# EasyEDA Pro project ProProject_Avaota Pi A_2024-03-25.epro, board PCB1 (continued)
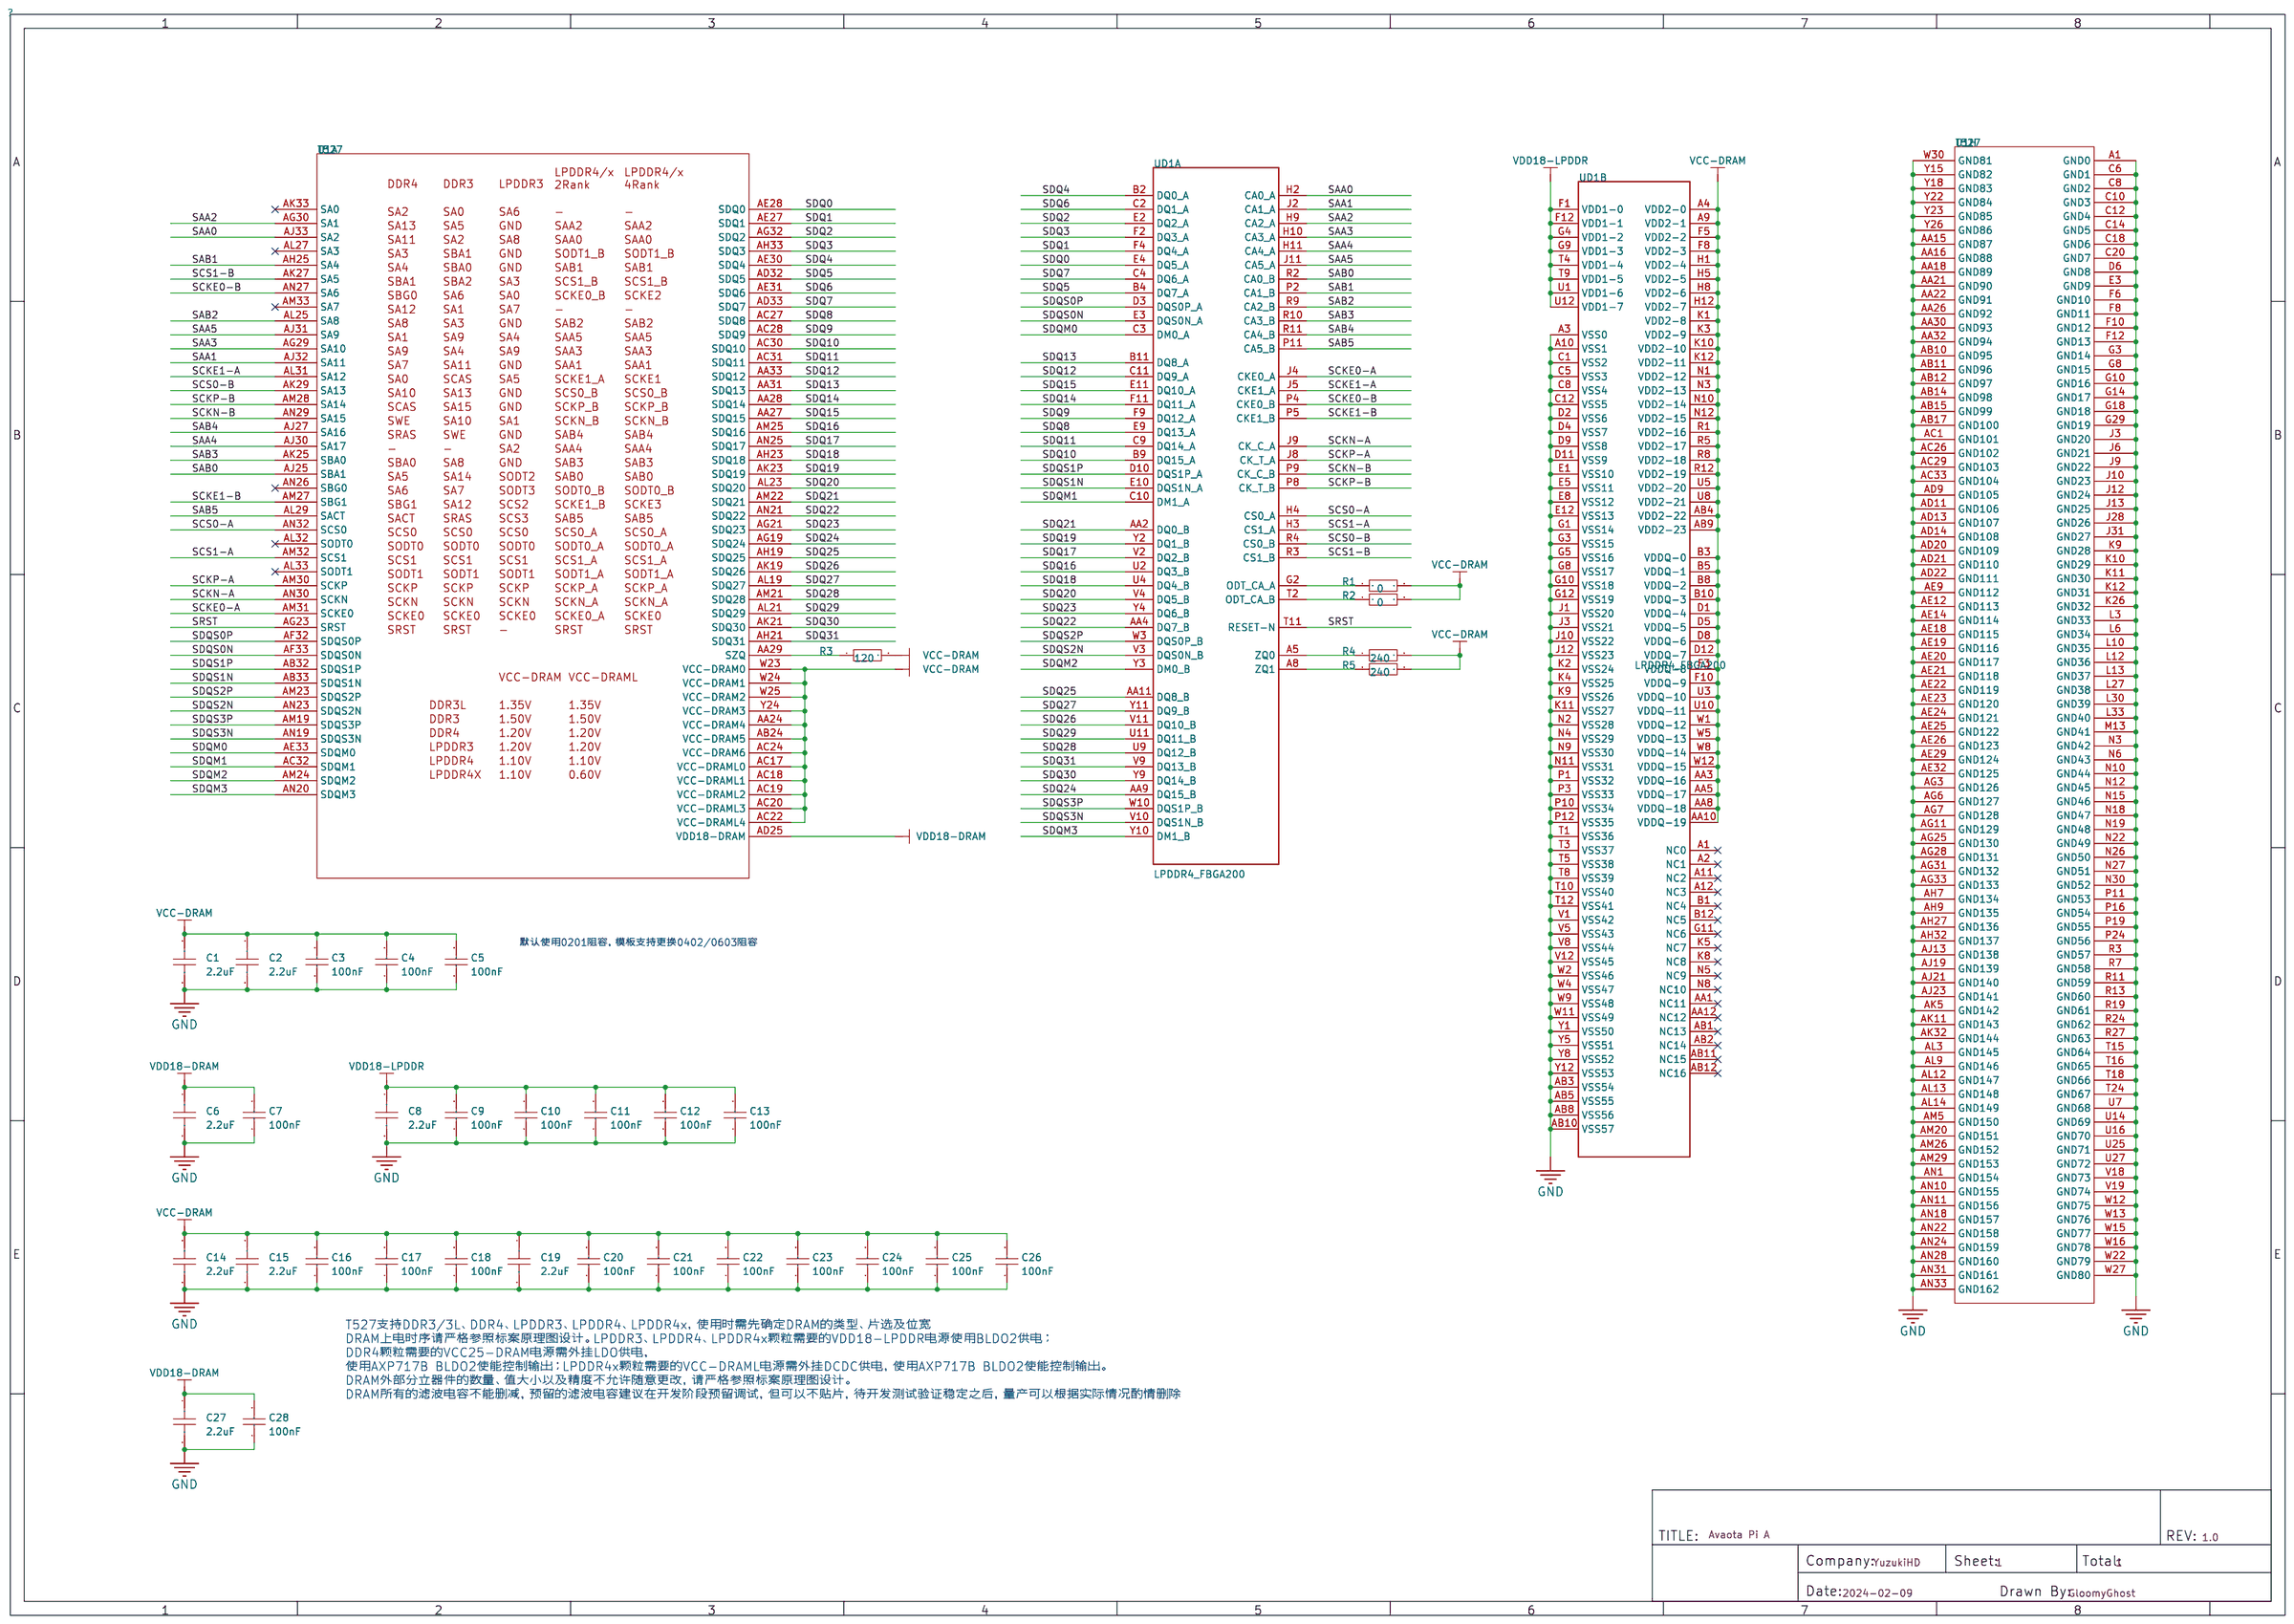
[diagram p0: schematic sheet]
## Routing (per net, layer and track width the routed paths; a pad name or vN(x,y) marks a point on that pad's centre or on a via; arc(x,y) is an arc through that point) (continued)
LCD0-D20: length 77
  Top Layer w0.102: v2(65.95,42.63) 65.92,42.63 U14.J29
  Inner5 w0.127: v2(30.33,26.52) 33.63,26.52 35.08,27.97 45.09,27.97 47.42,30.3 63.58,30.3 67.31,34.04 67.31,38.1 68.33,39.12 68.33,39.42 67.31,40.44 67.31,42.34 67.16,42.49 66.08,42.49 v2(65.95,42.63)
  Bottom Layer w0.127: FPC1.27 16.73,24.78 18.47,26.52 v2(30.33,26.52)
LCD0-D21: length 71.5
  Top Layer w0.102: U14.J30 65.92,42.13 v2(65.95,42.13)
  内层4 w0.127: v2(65.95,42.13) 66.32,41.76 66.32,38.84 65.53,38.05 65.53,37.24 60.68,32.39 57.66,32.39 56.92,31.65 40.46,31.65 35.84,27.03 31.67,27.03 v2(30.73,26.09)
  Bottom Layer w0.127: v2(30.73,26.09) 18.72,26.09 16.91,24.28 FPC1.28
LCD0-D22: length 70
  Top Layer w0.076: 65.44,40.65 65.44,40.51 65.69,40.26 65.69,39.26
  Top Layer w0.102: v2(27.3,25.6) 28.27,25.6 28.93,24.94 43.36,24.94 49.61,31.19 54.71,31.19 56.34,32.82 61.04,32.82 62.76,34.54 62.94,34.54 64.57,36.17 64.67,36.17 65.84,37.34 65.84,39.11 65.69,39.26
  Bottom Layer w0.127: FPC1.29 17.17,23.78 19,25.6 v2(27.3,25.6)
LCD0-D23: length 71.1
  Top Layer w0.076: 65.44,40.14 65.48,39.99 65.49,39.48 65.46,39.2 65.58,38.97
  Top Layer w0.102: 65.58,38.97 65.58,37.43 64.57,36.42 64.49,36.42 62.86,34.8 62.64,34.8 60.91,33.07 56.13,33.07 54.56,31.5 49.45,31.5 43.21,25.25 29.13,25.25 28.4,25.98 27.15,25.98 26.92,25.76 26.92,25.43 27.2,25.15 v2(27.71,25.15)
  Bottom Layer w0.127: FPC1.30 17.36,23.28 19.23,25.15 v2(27.71,25.15)
LCD0-DE: length 74.2
  Top Layer w0.076: 65,38.46 65,39.05 65.04,39.65 65.04,39.66 65.02,39.95 65.04,40.17 65.04,40.36 64.94,40.65 65,40.59
  Top Layer w0.102: v2(64.39,37.21) 65,37.83 65,38.46
  Inner5 w0.127: v2(64.39,37.21) 64.39,36.5 61.67,33.78 45.75,33.78 43.15,31.19 29.03,31.19 26.49,28.65 26.49,23.14 25.27,21.92 v2(23.44,21.92)
  Bottom Layer w0.127: FPC1.40 6.95,18.28 9.12,20.45 19.43,20.45 20.9,21.92 v2(23.44,21.92)
LCD0-HSYNC: length 84.3
  Top Layer w0.127: v2(64.95,42.65) U14.L28
  Inner5 w0.127: v2(64.95,42.65) 65.33,43.03 66.19,43.03 66.47,42.75 67.28,42.75 67.57,42.46 67.57,40.76 68.63,39.7 68.63,38.81 67.67,37.85 67.67,33.73 63.81,29.87 47.62,29.87 45.31,27.56 35.33,27.56 33.86,26.09 31.45,26.09 30.99,25.63 30.48,25.63 29.97,26.14 27.18,26.14 26.87,25.83 26.87,22.81 25.6,21.54 23.77,21.54 23.27,21.03 v2(22.45,21.03)
  Bottom Layer w0.127: FPC1.42 7.14,17.28 9.58,19.71 20.04,19.71 21.36,21.03 v2(22.45,21.03)
LCD0-PWM: length 77.5
  Top Layer w0.076: 64.44,41.15 64.69,40.9 64.69,40.62 64.72,40.52 64.77,40.45 64.86,40.16 64.79,39.57 64.8,39.26 64.8,39.25
  Top Layer w0.102: v2(64.24,37.77) 64.24,38.1 64.8,38.66 64.8,39.27
  内层2 w0.127: v2(64.24,37.77) 63.14,37.77 60.81,35.43 56.03,35.43 53.29,32.69 42.54,32.69 41.48,33.76 40.97,33.76 40.03,32.82 37.8,32.82 36.68,33.93 36.68,34.95 36.19,35.43 31.09,35.43 27.69,32.03 27.69,26.04 28.12,25.6 v2(28.12,24.66)
  Bottom Layer w0.127: FPC1.32 6.63,22.28 7.19,22.83 17.58,22.83 19.41,24.66 v2(28.12,24.66)
LCD0-RST: length 76.4
  Top Layer w0.076: 64.44,39.02 64.5,39.64 64.6,39.87 64.67,39.99 64.69,40.17 64.63,40.37 64.43,40.61
  Top Layer w0.102: v2(63.88,37.36) 63.88,38.13 64.44,38.68 64.44,39.03
  内层2 w0.127: v2(63.88,37.36) 63.3,37.36 61.01,35.08 56.26,35.08 53.47,32.28 37.85,32.28 36.3,33.83 36.3,34.77 35.99,35.08 31.27,35.08 28.09,31.9 28.09,26.21 28.5,25.81 v2(28.5,24.23)
  Bottom Layer w0.127: v2(28.5,24.23) 19.68,24.23 17.86,22.4 7.42,22.4 6.79,21.78 FPC1.33
LCD0-VSYNC: length 80.8
  Top Layer w0.127: U14.L29 v2(64.95,42.15)
  内层2 w0.127: v2(64.95,42.15) 64.61,42.15 64.36,42.39 64.36,42.73 64.07,43.03 63.7,43.03 63.32,42.65 63.32,39.4 62.86,38.94 62.86,38 60.66,35.79 55.8,35.79 53.19,33.17 42.65,33.17 41.71,34.11 40.77,34.11 40.23,33.58 39.19,33.58 38.81,33.96 38.81,34.47 38.46,34.82 37.47,34.82 36.5,35.79 30.81,35.79 27.23,32.21 27.23,26.42 26.77,25.96 26.77,24.05 25.5,22.78 24.87,22.78 23.55,21.46 v2(22.94,21.46)
  Bottom Layer w0.127: v2(22.94,21.46) 21.13,21.46 19.76,20.09 9.32,20.09 7.01,17.78 FPC1.41
LEDC: length 123.6
  Top Layer w0.076: v1(2.62,18.97) 2.62,18.97 LED2.3 ; v1(81.18,48.59) 79.2,48.59 77.39,50.39 68.69,50.39 U14.C13
  内层2 w0.076: v1(2.62,18.97) 5.61,15.98 34.26,15.98 38.86,20.57 50.09,20.57 51.26,21.74 57.12,21.74 59.64,19.23 61.87,19.23 63.3,20.65 69.19,20.65 69.8,20.04 74.52,20.04 78.13,23.65 78.13,25.22 81.69,28.78 81.69,48.08 v1(81.18,48.59)
MCSI0-CKN: length 41.4
  Top Layer w0.102: v1(71.5,52.45) 71.2,52.45 70.77,52.02 69.57,52.02 69.39,51.84 69.39,51.7 U14.A10
  Bottom Layer w0.102: v1(71.5,52.45) 71.5,52.73 71.69,52.92 79.29,52.92 83.01,49.2 83.01,40.01 84.33,38.68 84.33,35.79 86.01,34.11 90.51,34.11 90.63,33.98 90.89,33.98 91.01,34.11 91.27,34.11 91.39,33.98 91.65,33.98 91.78,34.11 92.03,34.11 92.16,33.98 92.41,33.98 92.54,34.11 92.79,34.11 92.92,33.98 93.17,33.98 93.3,34.11 93.79,34.11 93.94,33.96 FPC2.12
MCSI0-CKP: length 41.3
  Top Layer w0.102: U14.B10 68.94,51.67 69.49,52.22 70.68,52.22 71.07,52.61 v1(71.07,52.91)
  Bottom Layer w0.102: v1(71.07,52.91) 71.39,52.91 71.6,53.12 79.37,53.12 83.21,49.28 83.21,40.11 84.56,38.76 84.56,35.99 86.23,34.31 93.79,34.31 93.94,34.46 FPC2.13
MCSI0-D0N: length 42.9
  Top Layer w0.076: U14.A12 70.97,50.65 71.37,51.05
  Top Layer w0.102: 71.37,51.05 71.55,51.23 79.12,51.23 79.73,50.62 79.73,49.25 v1(79.58,49.1)
  Bottom Layer w0.102: v1(79.58,49.1) 79.58,48.82 80.11,48.29 80.11,39.22 82.12,37.21 82.12,33.55 84.55,31.12 90.65,31.12 90.77,30.99 91.03,30.99 91.15,31.12 91.41,31.12 91.53,30.99 91.79,30.99 91.92,31.12 92.17,31.12 92.3,30.99 92.55,30.99 92.68,31.12 92.93,31.12 93.06,30.99 93.31,30.99 93.44,31.12 93.85,31.12 93.95,31.01 94.54,31.01 FPC2.6
MCSI0-D0P: length 43
  Top Layer w0.076: 71.17,51.21 70.87,50.9 69.2,50.9 U14.B12
  Top Layer w0.102: v1(80.11,49.07) 79.91,49.28 79.91,50.73 79.21,51.44 71.4,51.44 71.17,51.21
  Bottom Layer w0.102: v1(80.11,49.07) 80.11,48.64 80.34,48.41 80.34,39.27 82.32,37.29 82.32,33.63 84.66,31.29 93.88,31.29 94.05,31.46 FPC2.7
MCSI0-D1N: length 43.2
  Top Layer w0.076: U14.B11 70.63,51.15 70.84,51.36
  Top Layer w0.102: 70.84,51.36 71.35,51.87 v1(72.09,51.87)
  Bottom Layer w0.102: FPC2.9 93.94,32.46 93.79,32.61 93.07,32.61 92.89,32.43 92.69,32.43 92.51,32.61 92.31,32.61 92.13,32.43 91.93,32.43 91.75,32.61 91.55,32.61 91.37,32.43 91.17,32.43 90.98,32.61 90.79,32.61 90.6,32.43 90.41,32.43 90.22,32.61 90.03,32.61 89.84,32.43 89.64,32.43 89.46,32.61 89.26,32.61 89.08,32.43 88.88,32.43 88.7,32.61 88.5,32.61 88.32,32.43 88.12,32.43 87.94,32.61 87.74,32.61 87.56,32.43 87.36,32.43 87.17,32.61 86.98,32.61 86.79,32.43 86.6,32.43 86.41,32.61 86.22,32.61 86.03,32.43 85.84,32.43 85.65,32.61 85,32.61 83.21,34.41 83.21,37.97 81.76,39.42 81.76,48.97 78.91,51.82 72.13,51.82 v1(72.09,51.87)
MCSI0-D1P: length 43.3
  Top Layer w0.127: U14.C11 68.43,51.13 v1(68,51.13)
  Bottom Layer w0.102: v1(68,51.13) 70.79,51.13 71.87,52.21 72.28,52.21 72.46,52.03 79.06,52.03 81.97,49.12 81.97,39.5 83.41,38.05 83.41,34.49 85.09,32.81 93.79,32.81 93.94,32.96 FPC2.10
MCSI0-D2N: length 40.8
  Top Layer w0.102: v2(66.93,51.13) 66.96,51.13 U14.E12
  Inner5 w0.102: v2(66.93,51.13) 67.51,50.55 80.35,50.55 83.34,47.57 83.34,37.61 85.34,35.61 89.72,35.61 89.87,35.46 v1(90.12,35.46)
  Bottom Layer w0.102: v1(90.12,35.46) 90.27,35.61 93.79,35.61 93.94,35.46 FPC2.15
MCSI0-D2P: length 40.8
  Top Layer w0.102: v2(67.46,51.13) 67.94,50.65 U14.D12
  Inner5 w0.102: v2(67.46,51.13) 67.46,50.93 67.63,50.76 68.29,50.76 68.42,50.89 68.67,50.89 68.8,50.76 69.05,50.76 69.18,50.89 69.44,50.89 69.56,50.76 69.82,50.76 69.94,50.89 70.2,50.89 70.32,50.76 70.58,50.76 70.7,50.89 70.96,50.89 71.09,50.76 71.34,50.76 71.47,50.89 71.72,50.89 71.85,50.76 80.43,50.76 83.54,47.65 83.54,37.69 85.42,35.81 89.72,35.81 89.87,35.97 v1(90.12,35.97)
  Bottom Layer w0.102: v1(90.12,35.97) 90.27,35.81 93.79,35.81 93.94,35.96 FPC2.16
MCSI0-D3N: length 41.1
  Top Layer w0.102: v2(67.44,52.15) 67.44,51.65 U14.E10
  Inner5 w0.102: v2(67.44,52.15) 67.61,51.97 67.61,51.77 67.85,51.53 68.57,51.53 70.43,53.39 72.64,53.39 74.12,51.92 80.98,51.92 84.71,48.18 84.71,38.47 86.09,37.09 93.05,37.09 93.21,36.93 v1(93.47,36.93)
  Bottom Layer w0.102: v1(93.47,36.93) 93.72,36.93 93.88,37.09 94.34,37.09
MCSI0-D3P: length 41.1
  Top Layer w0.102: U14.D10 67.94,52.14 v2(67.94,52.15)
  Inner5 w0.102: v2(67.94,52.15) 67.79,51.99 67.79,51.84 67.93,51.71 68.46,51.71 68.53,51.77 68.53,51.97 68.7,52.14 68.9,52.14 69.07,52.31 69.07,52.51 69.24,52.68 69.44,52.68 70.35,53.59 72.73,53.59 74.18,52.15 81.03,52.15 84.91,48.27 84.91,38.56 86.17,37.3 93.05,37.3 93.21,37.46 v1(93.46,37.46)
  Bottom Layer w0.102: v1(93.46,37.46) 93.72,37.46 93.88,37.3 94.34,37.3
MCSI0-MCLK: length 36.3
  Top Layer w0.152: U14.A6 69.44,53.62 v1(69.62,53.44)
  Bottom Layer w0.152: FPC2.24 94.52,40.03 84.88,40.03 84.1,40.82 84.1,49.61 79.86,53.85 70.03,53.85 v1(69.62,53.44)
MCSI0-PWDN: length 39
  Top Layer w0.076: 68.99,54.62 69.26,54.4 69.5,54.39 69.65,54.4 70.03,54.4
  Top Layer w0.102: v1(76.28,54.86) 75.82,54.41 70.03,54.41
  Bottom Layer w0.102: FPC2.28 94.11,41.96 93.88,41.73 86.21,41.73 85.47,42.47 85.47,49.91 80.19,55.19 77.57,55.19 77.19,55.58 75.72,55.58 75.23,55.09 75.23,54.74 75.49,54.48 75.9,54.48 v1(76.28,54.86)
MCSI0-RSTN: length 35.5
  Top Layer w0.102: U14.A4 75.47,54.65 v1(75.69,54.86)
  Bottom Layer w0.102: v1(75.69,54.86) 76.12,55.3 77.01,55.3 77.44,54.86 80.11,54.86 85.19,49.78 85.19,42.32 86.05,41.46 FPC2.27
MCSI0-SCK: length 39.7
  Top Layer w0.102: U14.E8 v2(67.44,53.13)
  Inner5 w0.102: v1(93.12,38.66) 93.09,38.66 91.95,39.8 89.61,39.8 85.88,43.54 85.88,48.69 81.61,52.96 74.9,52.96 73.41,54.46 69.95,54.46 68.22,52.73 67.69,52.73 67.44,52.98 v2(67.44,53.13)
  Bottom Layer w0.102: FPC2.21 93.31,38.46 v1(93.12,38.66)
  Bottom Layer w0.152: v2(67.44,53.13) 67.44,53.27 67.67,53.49 68.49,53.49 R127.2
MCSI0-SDA: length 38.1
  Top Layer w0.102: U14.D8 v2(67.94,53.13)
  Inner5 w0.102: v1(93.14,39.24) 92.96,39.24 92.15,40.06 89.79,40.06 86.16,43.69 86.16,48.84 81.74,53.26 75.08,53.26 73.61,54.74 69.8,54.74 68.19,53.13 v2(67.94,53.13)
  Bottom Layer w0.102: FPC2.22 93.42,38.96 v1(93.14,39.24)
  Bottom Layer w0.152: v2(67.94,53.13) 68.18,53.13 68.5,52.81 R128.2
MCSI0-USER: length 36.3
  Top Layer w0.076: 70.31,54.15 70,54.15 69.75,53.9 69.19,53.9 U14.B5
  Top Layer w0.102: v1(76.89,54.81) 76.23,54.15 70.31,54.15
  Bottom Layer w0.102: FPC2.26 94.11,40.96 93.95,41.12 85.98,41.12 84.89,42.22 84.89,49.71 80.04,54.56 77.29,54.56 77.04,54.81 v1(76.89,54.81)
MICIN3N: length 22.1
  Top Layer w0.076: v2(56.57,57.15) 56.6,57.15 56.76,56.99 56.76,56.43 56.94,56.25 56.94,56.14
  内层2 w0.127: v2(56.57,57.15) 56.57,57.55 56.66,57.64 56.66,57.91 57.47,58.73 62.18,58.73 64.72,61.27 65.99,61.27 v1(66.12,61.39)
  Bottom Layer w0.127: C241.1 69.89,67.75 70.07,67.57 70.07,66.79 70.41,66.45 70.41,64.64 68.66,62.89 67.79,62.89 66.29,61.39 v1(66.12,61.39)
MICIN3P: length 22.7
  Top Layer w0.076: 56.94,55.64 57.19,55.89 57.19,56.28 56.94,56.53 56.94,57.06 v2(57.1,57.22) 57.1,57.23
  内层2 w0.127: v1(66.12,60.76) 65.91,60.96 64.92,60.96 62.33,58.37 57.61,58.37 57.01,57.77 57.01,57.64 57.1,57.55 v2(57.1,57.22)
  Bottom Layer w0.127: v1(66.12,60.76) 67.92,62.56 68.65,62.56 70.64,64.55 70.64,66.55 70.3,66.88 70.3,67.57 70.48,67.75 C238.1
PE0: length 58
  Top Layer w0.102: U14.E6 67.94,54.15 v2(67.94,54.15)
  Inner5 w0.102: H1.12 21.89,71.93 21.89,69.82 23.29,68.43 26.11,68.43 27.86,66.68 53.06,66.68 57.71,62.03 59.61,62.03 63.93,57.71 63.93,57.1 65.53,55.5 67.11,55.5 67.29,55.31 67.29,54.6 67.74,54.15 v2(67.94,54.15)
PE1: length 50.3
  Top Layer w0.076: 70.48,55.04 70.34,54.89 68.69,54.9 68.44,54.64
  Top Layer w0.102: v2(72.67,57.2) 72.64,57.2 70.48,55.04
  VCC w0.102: 33.3,70.69 33.32,70.69 37.49,66.52 52.5,66.52 57.05,61.98 61.29,61.98 64.8,58.47 66.19,58.47 67.18,57.48 71.12,57.48 71.22,57.58 72.29,57.58 v2(72.67,57.2)
PE2: length 52.9
  Top Layer w0.102: U14.E5 v2(67.95,54.65)
  Inner5 w0.102: 23.14,70.69 25.04,68.78 26.24,68.78 27.99,67.03 53.26,67.03 57.94,62.36 59.77,62.36 64.26,57.86 64.26,57.25 65.68,55.83 67.23,55.83 67.59,55.47 67.59,54.87 67.78,54.68 67.93,54.68 v2(67.95,54.65)
PE3: length 55.1
  Top Layer w0.102: U14.E4 v2(67.95,55.15)
  Inner5 w0.102: v2(67.95,55.15) 67.95,55.65 67.44,56.16 65.76,56.16 64.59,57.33 64.59,58.12 60.02,62.69 58.14,62.69 53.47,67.36 28.19,67.36 26.39,69.16 25.04,69.16 24.46,69.75 24.46,72.16 24.88,72.58 25.03,72.58 H1.16
PE4: length 56.9
  Top Layer w0.076: 70.43,57.76 70.24,57.76 69.18,56.71 69.18,56 69.08,55.89 68.84,55.89 68.69,55.75 68.69,55.39 68.44,55.14
  Top Layer w0.102: 70.43,57.76 70.69,57.76 71.5,58.57 v2(71.5,58.6)
  Inner5 w0.102: v2(71.5,58.6) 70.51,57.61 65.71,57.61 59.51,63.81 57.53,63.81 53.64,67.69 28.45,67.69 25.68,70.46 25.68,70.69
PE5: length 52.3
  Top Layer w0.076: 70.08,55.5 69.97,55.4 69.19,55.4 68.94,55.14
  Top Layer w0.102: v2(71.58,57.2) 71.58,57 70.08,55.5
  VCC w0.102: H1.22 33.3,73.15 32.03,71.88 32.03,69.98 35.81,66.19 52.3,66.19 56.85,61.65 61.11,61.65 64.62,58.14 66.01,58.14 67.01,57.15 71.53,57.15 v2(71.58,57.2)
PE6: length 50.9
  Top Layer w0.076: 70.15,55.14 69.44,55.14
  Top Layer w0.102: 70.15,55.14 72.14,57.12 v2(72.14,57.2)
  VCC w0.102: v2(72.14,57.2) 72.14,57.15 71.81,56.82 66.88,56.82 65.84,57.86 64.36,57.86 60.96,61.27 56.77,61.27 52.17,65.86 35.53,65.86 30.76,70.64 30.76,70.69
PE7: length 52
  Top Layer w0.102: v2(72.62,58.62) 71.96,57.96 71.78,57.96 71.22,57.4 71.22,57.05 69.82,55.65 U14.A2
  VCC w0.102: v2(72.62,58.62) 72.62,58.34 72.11,57.84 71.07,57.84 71.02,57.79 67.36,57.79 66.37,58.78 65,58.78 61.47,62.31 57.2,62.31 52.65,66.85 37.69,66.85 34.62,69.93 34.62,72.03 35.81,73.23 H1.24
PE8: length 46.5
  Top Layer w0.076: 68.94,55.64 69.07,55.64 69.31,55.89 69.65,55.89 70,56.24
  Top Layer w0.102: 70,56.24 70.89,57.12 70.89,57.48 71.68,58.27 71.82,58.27 72.06,58.51 v2(72.06,58.6)
  VCC w0.102: v2(72.06,58.6) 71.55,58.09 67.49,58.09 66.5,59.08 65.2,59.08 61.59,62.69 57.38,62.69 52.81,67.26 38.81,67.26 35.84,70.23 35.84,70.69
PE9: length 56.6
  Top Layer w0.102: 68.94,56.14 68.94,56.77 70.21,58.04 70.46,58.04 70.94,58.52 v2(70.94,58.6)
  Inner5 w0.102: H1.18 28.22,73.18 26.97,71.93 26.97,69.67 28.63,68.02 53.85,68.02 57.63,64.24 59.72,64.24 66.07,57.89 70.23,57.89 v2(70.94,58.6)
PE10: length 39.4
  Top Layer w0.076: 68.83,56.94 68.69,56.8 68.69,56.01 68.44,55.76 68.44,55.64
  Top Layer w0.115: v2(70.41,58.6) 70.37,58.6 70.07,58.29 69.91,58.29 68.83,57.22 68.83,56.94
  Inner5 w0.102: 40.92,70.69 43.26,68.35 54.81,68.35 58.06,65.1 59.49,65.1 60.22,64.36 61.32,64.36 61.52,64.16 61.52,62.97 66.32,58.17 69.98,58.17 v2(70.41,58.6)
PE11: length 59.8
  Top Layer w0.102: v2(65.95,53.15) U14.J7
  Inner5 w0.102: v2(65.95,53.15) 65.91,53.15 65.35,53.7 65.35,54.79 62.59,57.56 61.37,57.56 60.55,58.37 60.55,60.07 59.23,61.39 57.2,61.39 52.58,66.01 27.48,66.01 25.81,67.69 18.52,67.69 15.52,70.69
PE12: length 44.7
  Top Layer w0.102: U14.C1 68.5,56.21 68.5,57.33 v2(69.8,58.62)
  VCC w0.102: v2(69.8,58.62) 69.57,58.39 67.72,58.39 66.67,59.44 65.41,59.44 61.77,63.07 59.72,63.07 58.95,63.83 56.79,63.83 52.96,67.67 38.86,67.67 37.13,69.39 37.13,71.98 H1.26
PE13: length 55.2
  Top Layer w0.254: U14.G6 v2(66.95,54.15)
  Inner5 w0.102: v2(66.95,54.15) 66.57,54.15 66.42,54.31 66.42,54.76 66.09,55.09 65.48,55.09 62.69,57.89 61.54,57.89 60.86,58.57 60.86,60.25 59.44,61.67 57.45,61.67 52.78,66.35 27.69,66.35 25.96,68.07 23.09,68.07 20.6,70.56 20.6,70.69
PE14: length 61.7
  Top Layer w0.102: v2(64.95,53.15) U14.L7
  Inner5 w0.102: 12.98,70.69 16.36,67.31 25.63,67.31 27.25,65.68 52.41,65.68 57.01,61.09 59.06,61.09 60.25,59.89 60.25,58.17 61.16,57.25 62.48,57.25 64.31,55.42 64.31,54.33 64.57,54.08 64.57,53.53 v2(64.95,53.15)
PE15: length 63.1
  Top Layer w0.102: v2(63.95,53.15) U14.N7
  Inner5 w0.102: v2(63.95,53.15) 64.12,53.15 64.31,53.34 64.31,53.92 63.96,54.28 63.96,55.3 62.86,56.39 61.52,56.39 57.73,60.17 56.29,60.17 55.68,60.78 49.63,60.78 45.03,65.38 27,65.38 25.43,66.95 13.84,66.95 10.44,70.36 10.44,70.69
PGAOUT0: length 6.5
  Top Layer w0.152: v2(61.95,52.65) 61.45,52.65 U14.U8
  Bottom Layer w0.076: v2(61.95,52.65) 62.56,53.26
  Bottom Layer w0.152: R26.1 60.71,56.24 60.86,56.39 62.18,56.39 62.59,55.98 62.59,53.29 62.56,53.26
PGAOUT1: length 4
  Bottom Layer w0.152: v2(61.44,51.65) 61.44,54.89 61.76,55.21 R27.1
PHYRSTB0: length 46.9
  Top Layer w0.127: U12.12 v2(70.39,21.03) 70.93,21.03 R90.2 ; U14.D16 v2(67.94,49.15)
  内层2 w0.102: v2(70.39,21.03) 72.01,21.03 72.01,21.03 72.97,21.03 73.58,21.64 73.58,23.6 79.45,29.46 79.45,47.02 76.45,50.01 74.88,50.01 74.63,50.27 72.8,50.27 72.42,49.89 70.05,49.89 69.32,49.15 v2(67.94,49.15)
PHYRSTB1: length 71.3
  Top Layer w0.102: v2(89.53,51.23) 89.53,51.26 88.62,52.17 88.47,52.17 88.04,52.6 88.04,57.99 83.85,62.18 68.41,62.18 65.94,59.71 65.94,57.3 65.58,56.95 65.58,56.29 U14.J1
  Top Layer w0.152: U13.12 88.99,20.89 R108.2
  内层2 w0.102: v2(89.53,51.23) 89.28,50.98 89.28,28.98 90.07,28.19 90.07,26.7 91.52,25.25 91.52,24.33 90.6,23.42 90.27,23.42 89.99,23.14 89.99,22.66 90.14,22.5 90.14,21.64 89.31,20.8 v2(88.65,20.8)
PMU-SCK: length 72.4
  Top Layer w0.102: U14.AN6 53.34,53.75 52.53,53.75 51.49,54.79 51.49,55.6 50.39,56.69 v1(37.36,56.69)
  Top Layer w0.152: U4.52 5.51,49.43 v2(5.16,49.07) 5.18,49.05 R11.2 ; U5.6 15.09,44.06 15.09,44.68 14.78,44.98 13.13,44.98 13.03,44.88 12.75,44.88 v2(12.32,45.31)
  Bottom Layer w0.102: v1(37.36,56.69) 36.55,56.69 35.86,56.01 14.4,56.01 12.47,54.08 12.47,50.06 11.1,48.69 6.26,48.69 5.65,49.3 5.38,49.3 v2(5.16,49.07) 5.16,48.9 5.82,48.23 5.82,46.05 6.93,44.93 11.94,44.93 v2(12.32,45.31)
PMU-SDA: length 75.2
  Top Layer w0.076: 53.43,54.14 53.44,54.14
  Top Layer w0.102: U14.AN5 53.43,54.14 53.25,53.95 52.63,53.95 51.71,54.86 51.71,55.73 50.52,56.92 37.72,56.92 37.57,57.07 v1(36.75,57.07) ; U4.51 5.77,49.81 6.17,49.81 6.25,49.73 6.25,49.4 5.71,48.86 R12.2
  Top Layer w0.152: U5.5 15.45,44.7 14.88,45.26 12.9,45.26 v2(12.85,45.31) ; U4.51 5.35,49.83 v2(5.13,49.61)
  Bottom Layer w0.102: v1(36.75,57.07) 36.42,57.07 35.66,56.31 13.51,56.31 12.24,55.04 12.24,50.24 10.97,48.97 6.35,48.97 5.71,49.61 v2(5.13,49.61) 4.8,49.28 4.8,48.92 5.56,48.16 5.56,45.92 6.78,44.7 12.24,44.7 v2(12.85,45.31)
PS: length 28
  Top Layer w0.203: U4.9 9.46,49.42 v2(9.58,49.53) ; U5.20 17.66,44.16 v2(17.65,44.17) ; v2(9.32,54.15) 9.46,54.3 U4.31 ; v2(10.95,52.02) 11.14,51.83 U4.20 12.85,51.83 C17.1 ; C55.1 12.47,48.97 12.17,49.28 12.17,49.63 11.97,49.83 U4.15 11.21,49.83 v2(11.02,50.01) ; U5.17 18.04,42.61 18.19,42.47 v2(18.19,41.81) ; v2(8.79,54.15) 9.06,54.43 U4.32 9.06,55.15 v2(8.99,55.22) ; U5.2 16.65,44.96 v2(16.79,45.1) ; C12.1 12.6,54.51 11.92,53.83 U4.25 11.12,53.83 v2(10.95,54)
  Top Layer w0.381: v2(17.65,44.17) 17.91,44.42 17.91,45.03 C70.2
  Top Layer w0.406: v2(18.19,41.81) 18.19,40.26 17.84,39.92 C284.2
  Top Layer w0.508: C284.2 C283.2
  Bottom Layer w0.102: v2(11.02,50.01) C46.1
  Bottom Layer w0.381: v2(10.95,52.02) 11.1,52.17 11.1,52.43 ; 11.1,53.31 11.1,53.85 v2(10.95,54) ; v2(9.58,49.53) 9.68,49.43 C30.1
  Bottom Layer w0.508: C79.2 6.13,51.05 v2(6.38,50.81) ; C79.2 6.02,51.28 v2(6.38,51.28) ; C79.2 C29.1 5.79,52.83 5.82,52.86 v2(6.38,52.86) 6.5,52.98 C26.1 ; v2(10.95,52.02) 10.95,51.45 11.05,51.35 ; C286.2 8.79,55.13 v2(8.79,54.15) ; v2(9.32,54.15) 9.32,55.28 C285.2 ; 5.89,52.38 v2(6.38,52.38)
PWRON: length 21.8
  Top Layer w0.102: v2(8.66,49.5) 8.26,49.11 U4.6 8.26,48.19 C11.1
  Top Layer w0.152: C97.2 3.49,65.34 4.32,64.52 v1(4.32,63.53)
  Top Layer w0.254: C97.2 R23.2
  Inner5 w0.152: v1(4.32,63.53) 3.91,63.12 3.91,56.72 7.01,53.62 7.57,53.62 7.9,53.29 7.9,50.27 v2(8.66,49.5)
RF: length 3.7
  Top Layer w0.127: R72.1 C244.2 15.68,64.17 15.72,64.2
RGMII0-CLKIN: length 47.9
  Top Layer w0.076: 68.44,48.14 68.69,47.89 69.78,47.9 69.99,48.11 70.26,48.11 70.33,48.18 70.56,48.18
  Top Layer w0.102: v2(74.04,49.28) 72.95,48.18 70.56,48.18
  Top Layer w0.127: U12.35 v2(63.35,22.63)
  内层2 w0.102: v2(63.35,22.63) 63.52,22.45 71.7,22.45 72.31,23.06 72.31,24 78.51,30.2 78.51,46.51 75.84,49.17 74.14,49.17 v2(74.04,49.28)
RGMII0-MDC: length 43.5
  Top Layer w0.076: 68.44,48.64 68.69,48.39 69.04,48.39 69.14,48.3 69.67,48.3 69.9,48.53 ; 69.9,48.53 69.9,48.54
  Top Layer w0.102: 69.88,48.51 70.04,48.69 72.24,48.69 v2(72.85,49.3) ; U12.13 72.35,21.43 v2(72.42,21.49)
  内层2 w0.102: v2(72.42,21.49) 72.72,21.79 72.72,23.88 78.82,29.97 78.82,46.66 76.05,49.43 74.47,49.43 74.24,49.66 73.2,49.66 v2(72.85,49.3)
RGMII0-MDIO: length 44.1
  Top Layer w0.076: 71.98,49 71.91,48.92 69.22,48.92 U14.B16
  Top Layer w0.102: 71.98,49 v2(72.29,49.3)
  Top Layer w0.127: v2(73.18,21.82) 72.72,21.82 72.26,22.28 71.23,22.28 70.93,21.98 R83.2 70.91,21.83 U12.14
  内层2 w0.102: v2(73.18,21.82) 73.1,21.9 73.1,23.67 79.12,29.69 79.12,46.84 76.25,49.71 74.7,49.71 74.47,49.94 72.92,49.94 v2(72.29,49.3)
RGMII0-RXCK: length 42.7
  Top Layer w0.076: v2(70.66,49.33) 70.29,49.7 69.84,49.7 69.54,49.4 69.34,49.4 69.1,49.64 68.94,49.64
  Top Layer w0.127: v2(66.19,26.76) 66.19,26.54 66,26.35 U12.27
  内层2 w0.102: v2(66.19,26.76) 66.42,26.53 66.42,25.2 67.39,24.23 70.51,24.23 77.27,30.99 77.27,45.92 75.16,48.03 71.96,48.03 v2(70.66,49.33)
RGMII0-RXCTL: length 42.2
  Top Layer w0.127: U14.D18 v2(67.94,48.15) ; U12.26 66.4,26.14 66.75,26.49 v2(66.75,26.76)
  内层2 w0.102: v2(66.75,26.76) 66.75,25.3 67.49,24.56 70.28,24.56 76.91,31.19 76.91,45.87 75.11,47.68 71.75,47.68 70.79,48.64 68.43,48.64 v2(67.94,48.15)
RGMII0-RXD0: length 41.5
  Top Layer w0.127: v2(67.34,26.76) 67.34,26.49 66.8,25.96 U12.25 ; U14.E18 v2(67.44,48.15)
  内层2 w0.102: v2(67.44,48.15) 67.44,47.93 67.59,47.78 68.1,47.78 68.61,48.29 70.69,48.29 71.6,47.37 74.93,47.37 76.58,45.72 76.58,31.39 70.03,24.84 67.64,24.84 67.11,25.37 67.11,26.39 67.34,26.62 v2(67.34,26.76)
RGMII0-RXD1: length 40.5
  Top Layer w0.127: v2(67.96,26.76) 67.96,26.56 67.2,25.8 U12.24 ; U14.F18 v2(66.94,48.15)
  内层2 w0.102: v2(66.94,48.15) 66.94,48.02 67.42,47.54 68.34,47.54 68.76,47.96 70.56,47.96 71.48,47.04 74.78,47.04 76.25,45.57 76.25,31.62 69.75,25.12 67.87,25.12 67.46,25.53 67.46,26.26 v2(67.96,26.76)
RGMII0-RXD2: length 48.8
  Top Layer w0.127: 67.6,24.93 67.6,25.64 68.55,26.59 v2(68.55,26.76) ; U14.D14 v2(67.94,50.15)
  内层4 w0.102: v2(68.55,26.76) 68.55,26.24 69.77,25.02 76.78,25.02 80.57,28.8 80.57,45.82 78.21,48.18 70.03,48.18 68.06,50.15 v2(67.94,50.15)
RGMII0-RXD3: length 48.1
  Top Layer w0.127: v2(67.44,50.15) U14.E14 ; v2(69.19,26.76) 69.19,26.67 68,25.48 U12.22
  内层4 w0.102: v2(67.44,50.15) 67.84,49.76 68.05,49.76 69.9,47.9 78.03,47.9 80.29,45.64 80.29,28.91 76.68,25.3 69.93,25.3 68.94,26.29 68.94,26.5 v2(69.19,26.76)
RGMII0-TXCK: length 50.4
  Top Layer w0.102: U12.20 69.57,24.23 69.82,24.49 72.29,24.49 73.03,23.75 74.7,23.75 75.26,24.31 76.45,24.31 v2(76.84,23.93) ; v2(66.42,50.17) 66.42,50.62 U14.G12
  内层2 w0.076: v2(66.42,50.17) 66.78,50.52 68.07,50.52 68.43,50.17 68.94,50.17 69.04,50.27
  内层2 w0.102: 69.04,50.27 69.49,50.72 71.91,50.72 72.42,51.23 75.16,51.23 75.41,50.98 76.99,50.98 80.44,47.52 80.44,28.78 76.84,25.17 v2(76.84,23.93)
RGMII0-TXCTL: length 48.6
  Top Layer w0.102: U12.19 69.62,23.83 69.98,24.18 72.09,24.18 72.85,23.42 74.83,23.42 75.31,23.9 v2(76.2,23.9)
  Top Layer w0.127: U14.F14 v2(66.94,50.15)
  内层2 w0.102: v2(66.94,50.15) 67.36,49.73 69.01,49.73 69.7,50.42 72.03,50.42 72.52,50.9 74.96,50.9 75.21,50.65 76.81,50.65 80.11,47.35 80.11,29.03 76.45,25.37 76.45,24.16 v2(76.2,23.9)
RGMII0-TXD0: length 47.5
  Top Layer w0.102: U12.18 69.76,23.43 70.16,23.83 71.98,23.83 72.75,23.06 75.03,23.06 75.46,23.5 v2(75.62,23.5)
  Top Layer w0.127: U14.E16 v2(67.44,49.15)
  内层2 w0.102: v2(67.44,49.15) 67.79,49.5 69.24,49.5 69.9,50.17 72.19,50.17 72.62,50.6 74.78,50.6 75.03,50.34 76.63,50.34 79.78,47.19 79.78,29.24 76.1,25.55 76.1,24.38 75.62,23.9 v2(75.62,23.5)
RGMII0-TXD1: length 39.9
  Top Layer w0.076: 70.43,48.44 70.08,48.44 69.71,48.07 69.02,48.07 68.94,48.14
  Top Layer w0.102: v2(70.16,23.11) 70.07,23.03 U12.17 ; v2(73.46,49.3) 72.59,48.44 70.43,48.44
  内层2 w0.102: v2(70.16,23.11) 70.41,22.86 71.65,22.86 71.96,23.17 71.96,24.13 78.23,30.4 78.23,46.3 75.64,48.9 73.86,48.9 v2(73.46,49.3)
RGMII0-TXD2: length 37.5
  Top Layer w0.076: v2(71.2,49.33) 70.87,49.66 70.62,49.66 70.36,49.91 69.71,49.91 69.44,49.64
  Top Layer w0.102: v2(70.97,23.34) 70.25,22.63 U12.16
  内层2 w0.102: v2(71.2,49.33) 72.19,48.34 75.29,48.34 77.6,46.03 77.6,30.79 71.2,24.38 71.2,23.57 v2(70.97,23.34)
RGMII0-TXD3: length 39
  Top Layer w0.102: U12.15 70.51,22.23 71.55,23.27 v2(71.55,23.34) ; v2(71.73,49.33) 71.2,49.86 70.76,49.86 70.51,50.11 68.97,50.11 U14.B13
  内层2 w0.102: v2(71.55,23.34) 71.55,24.23 77.93,30.61 77.93,46.13 75.44,48.62 72.44,48.62 v2(71.73,49.33)
RGMII1-CLKIN: length 59
  Top Layer w0.076: 68.3,58.32 68.3,58.3 67.7,57.71 67.7,55.91 67.44,55.64
  Top Layer w0.102: v2(83.16,53.72) 83.49,54.05 83.97,54.05 84.28,54.36 84.28,55.12 84.07,55.32 84.07,57.38 81.64,59.82 69.8,59.82 68.3,58.32